# EAGLE schematic MS14-N.v1.4 (EAGLE 7.5.0)

## Sheet 1 of 5
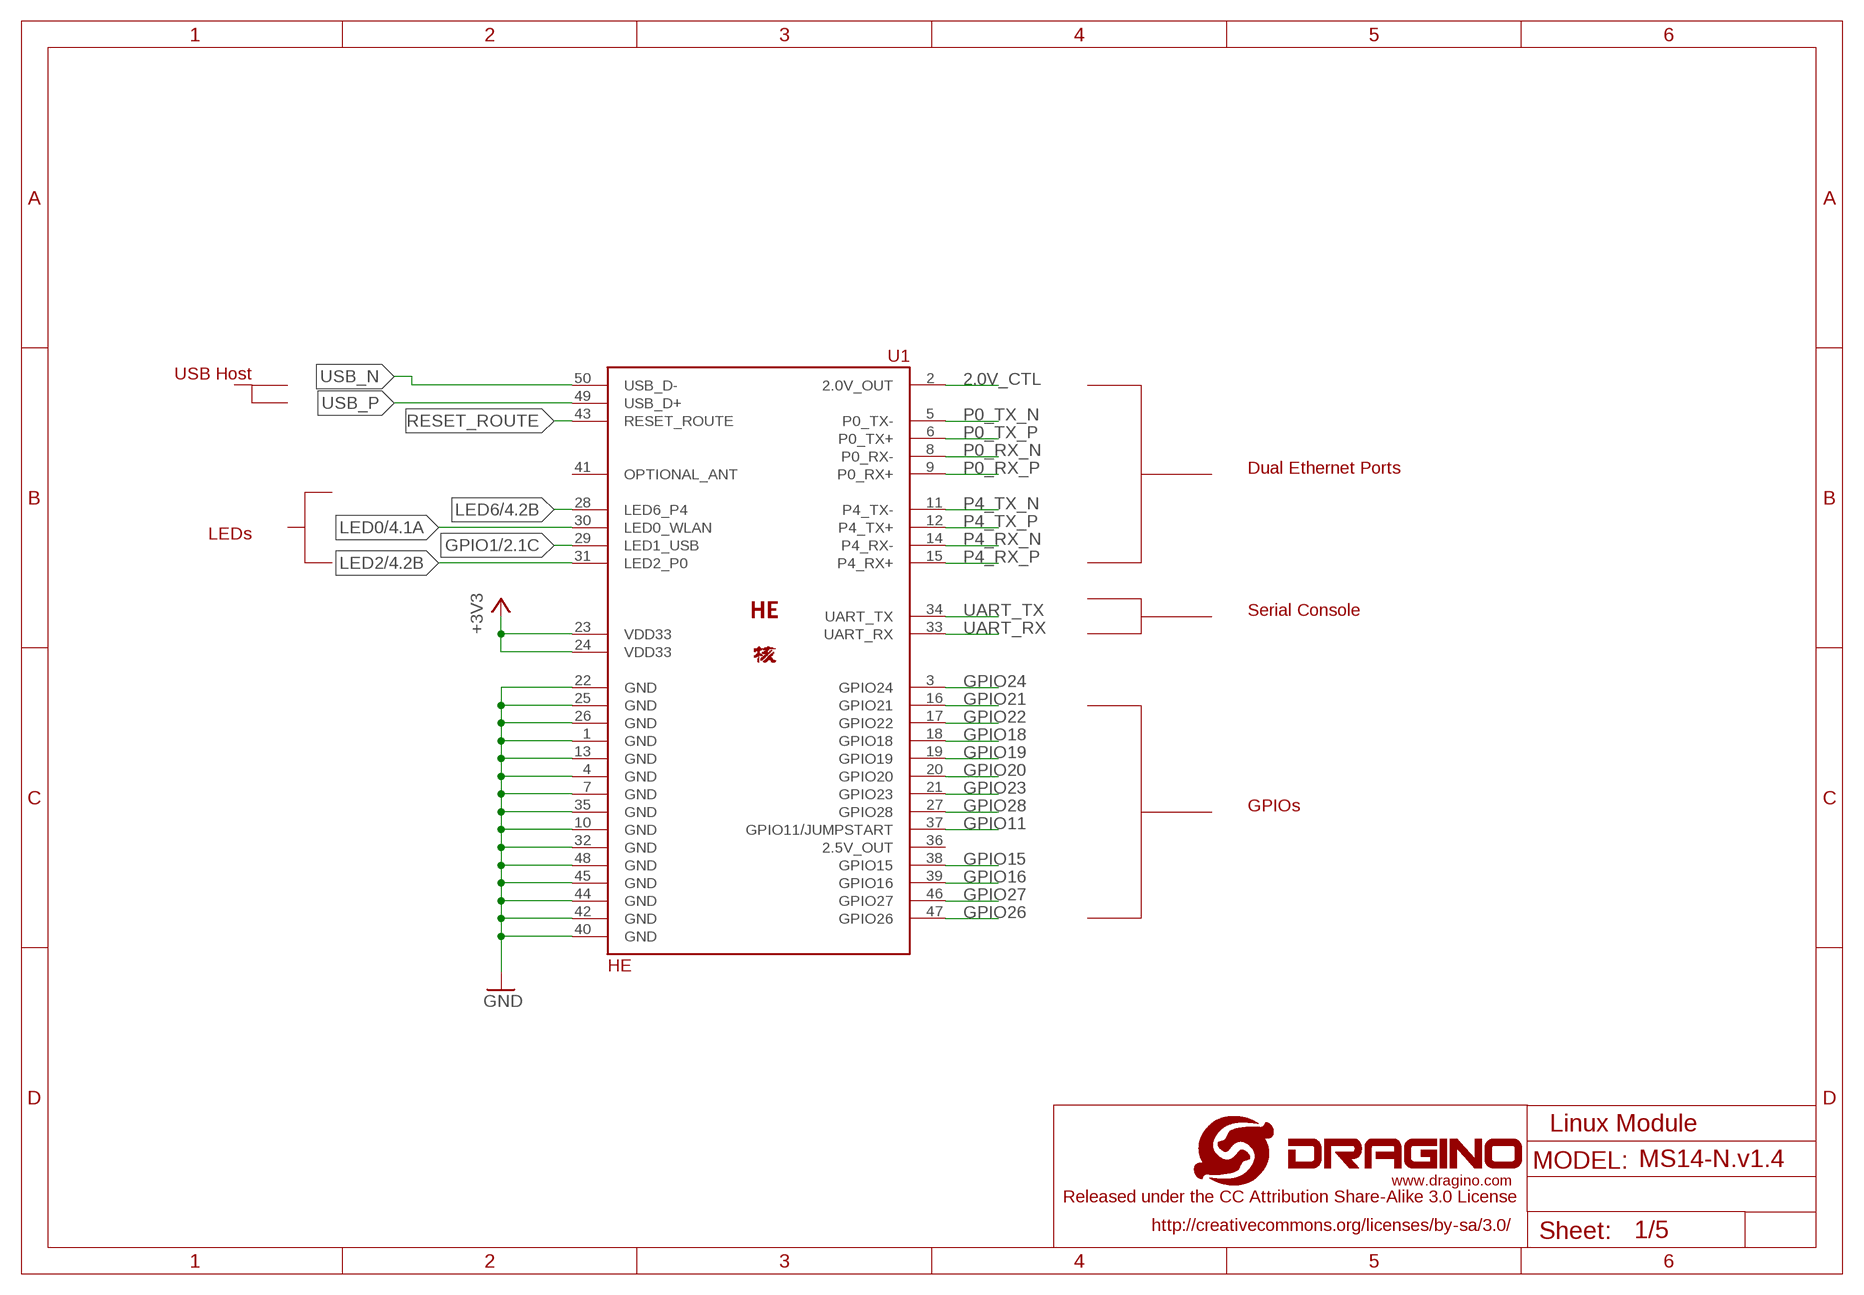
[diagram p0: schematic, sheet 1]

### Parts
U1  HE  [HE50]

### Nets
2.0V_CTL: U1.2(2.0V_OUT) ; also sheet 3
+3V3: U1.23(VDD33) U1.24(VDD33) ; also sheet 2,4
GND [gnd]: U1.1(GND) U1.4(GND) U1.7(GND) U1.10(GND) U1.13(GND) U1.22(GND) U1.25(GND) U1.26(GND) U1.32(GND) U1.35(GND) U1.40(GND) U1.42(GND) U1.44(GND) U1.45(GND) U1.48(GND) ; also sheet 2,3,4,5
GPIO1: U1.29(LED1_USB) ; also sheet 2
GPIO11: U1.37(GPIO11/JUMPSTART) ; also sheet 4
GPIO15: U1.38(GPIO15) ; also sheet 4
GPIO16: U1.39(GPIO16) ; also sheet 4
GPIO18: U1.18(GPIO18) ; also sheet 4
GPIO19: U1.19(GPIO19) ; also sheet 4
GPIO20: U1.20(GPIO20) ; also sheet 4
GPIO21: U1.16(GPIO21) ; also sheet 4
GPIO22: U1.17(GPIO22) ; also sheet 4
GPIO23: U1.21(GPIO23) ; also sheet 4
GPIO24: U1.3(GPIO24) ; also sheet 4
GPIO26: U1.47(GPIO26) ; also sheet 4
GPIO27: U1.46(GPIO27) ; also sheet 4
GPIO28: U1.27(GPIO28) ; also sheet 4
LED0: U1.30(LED0_WLAN) ; also sheet 4
LED2: U1.31(LED2_P0) ; also sheet 4
LED6: U1.28(LED6_P4) ; also sheet 4
P0_RX_N: U1.8(P0_RX-) ; also sheet 3
P0_RX_P: U1.9(P0_RX+) ; also sheet 3
P0_TX_N: U1.5(P0_TX-) ; also sheet 3
P0_TX_P: U1.6(P0_TX+) ; also sheet 3
P4_RX_N: U1.14(P4_RX-) ; also sheet 3
P4_RX_P: U1.15(P4_RX+) ; also sheet 3
P4_TX_N: U1.11(P4_TX-) ; also sheet 3
P4_TX_P: U1.12(P4_TX+) ; also sheet 3
RESET_ROUTE: U1.43(RESET_ROUTE) ; also sheet 4
UART_RX: U1.33(UART_RX) ; also sheet 4
UART_TX: U1.34(UART_TX) ; also sheet 4
USB_N: U1.50(USB_D-) ; also sheet 5
USB_P: U1.49(USB_D+) ; also sheet 5
Unconnected: U1.36(2.5V_OUT)

### Notes on the sheet
- USB Host
- Dual Ethernet Ports
- LEDs
- Serial Console
- GPIOs
- Linux Module

## Sheet 2 of 5
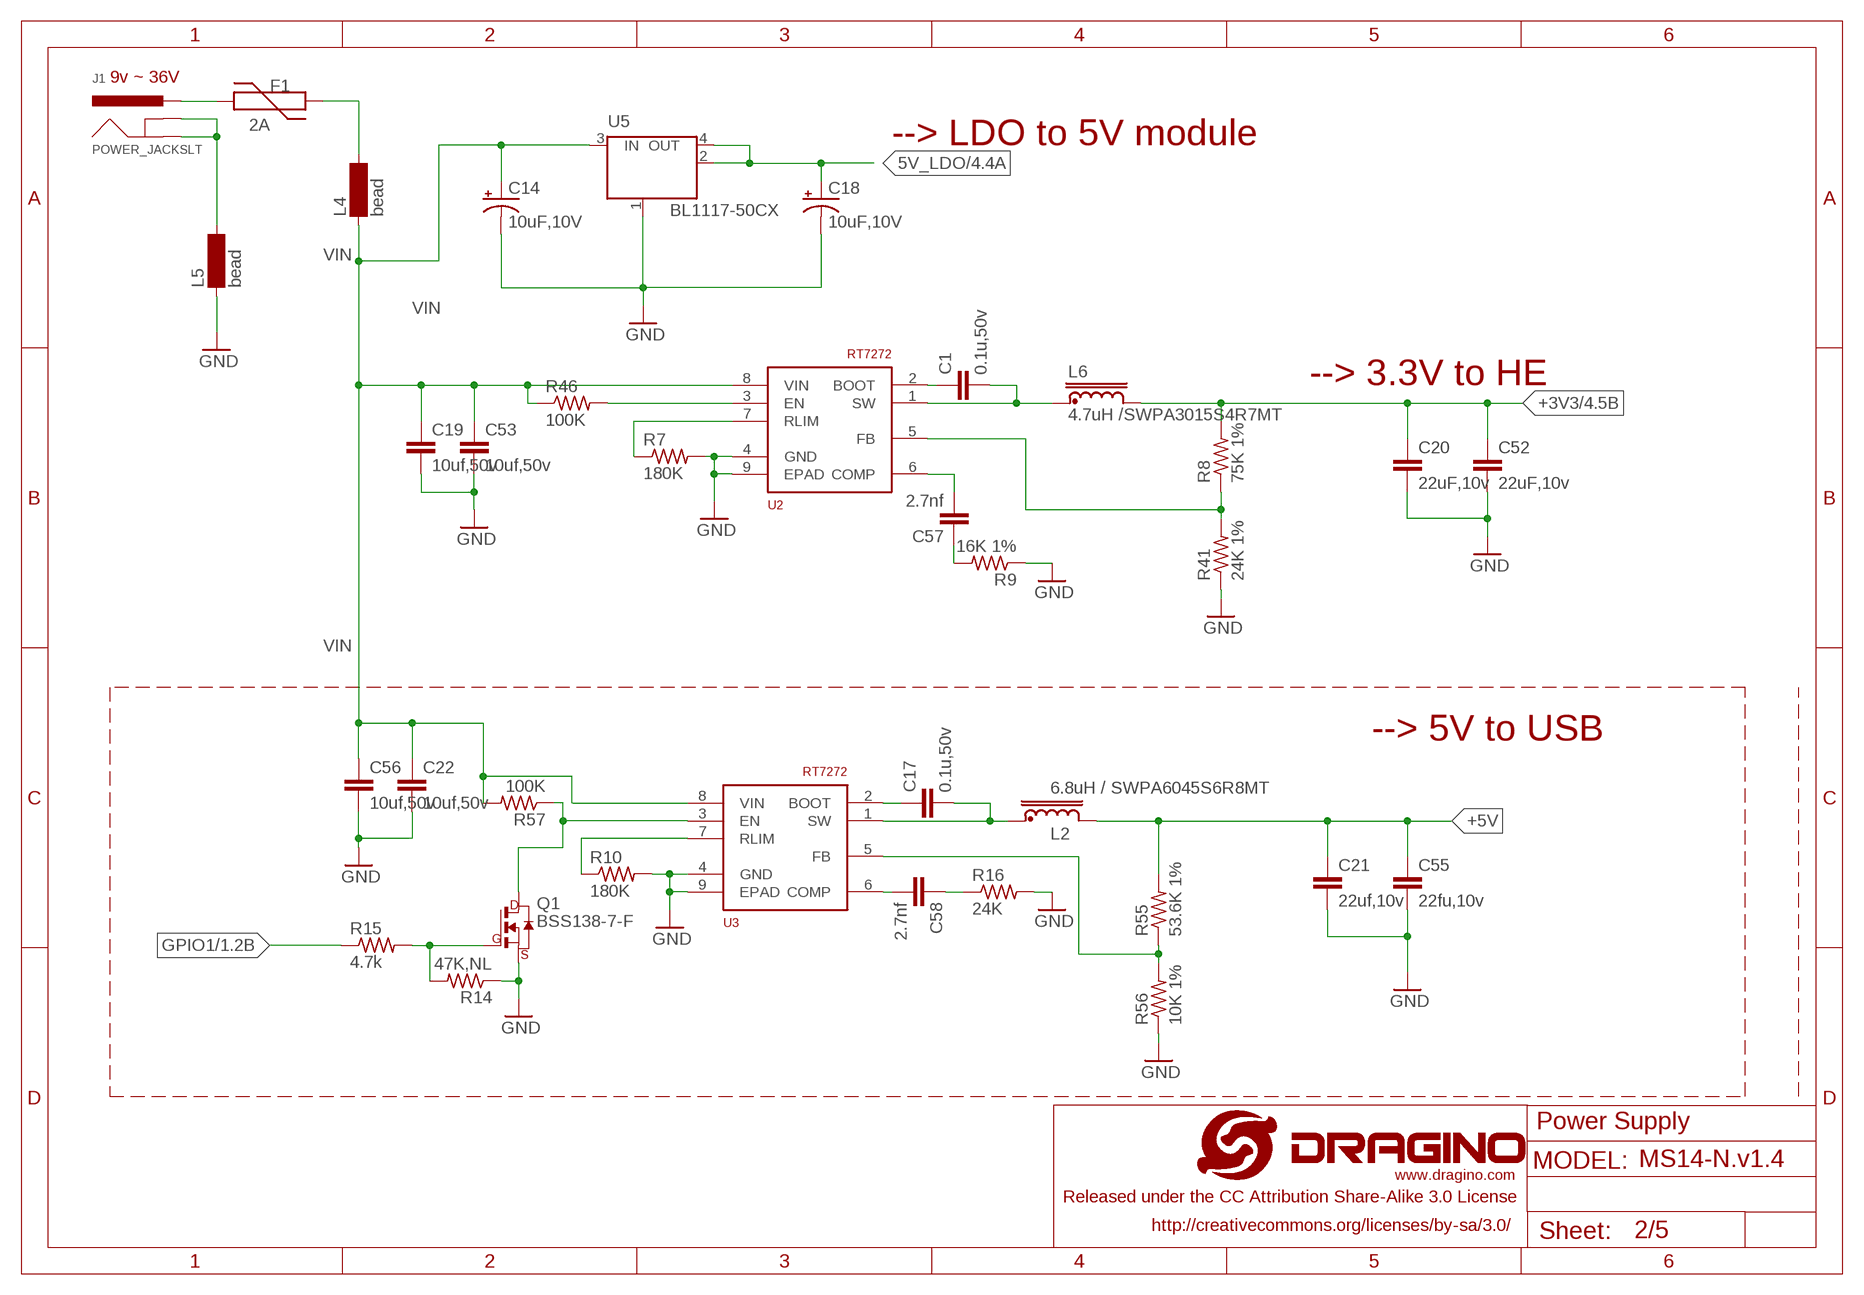
[diagram p1: schematic, sheet 2]

### Parts
C1  0.1u,50v  C-EUC0402  [C0402]
C14  10uF,10V  CPOL-USSMCA  [SMC_A]
C17  0.1u,50v  C-EUC0402  [C0402]
C18  10uF,10V  CPOL-USSMCA  [SMC_A]
C19  10uf,50v  C-EUC1206K  [C1206K]
C20  22uF,10v  C-EUC1210  [C1210]
C21  22uf,10v  C-EUC1210  [C1210]
C22  10uf,50v  C-EUC1206K  [C1206K]
C52  22uF,10v  C-EUC1210  [C1210]
C53  10uf,50v  C-EUC1206K  [C1206K]
C55  22fu,10v  C-EUC1210  [C1210]
C56  10uf,50v  C-EUC1206K  [C1206K]
C57  2.7nf  C-EUC0402  [C0402]
C58  2.7nf  C-EUC0402  [C0402]
F1  2A  FUSE1812  [L1812]
J1  POWER_JACKSLT  [POWER_JACK_SLOT]
L2  6.8uH / SWPA6045S6R8MT  INDUCTOR6028S  [SWPA6028S]
L4  bead  BS11  [BS11]
L5  bead  BS11  [BS11]
L6  4.7uH /SWPA3015S4R7MT  INDUCTORSWPA3010S  [SWPA3010S]
Q1  BSS138-7-F  NMOSFET  [SOT-23]
R7  180K  R-US_R0402  [R0402]
R8  75K 1%  R-US_R0402  [R0402]
R9  16K 1%  R-US_R0402  [R0402]
R10  180K  R-US_R0402  [R0402]
R14  47K,NL  R-US_R0402  [R0402]
R15  4.7k  R-US_R0402  [R0402]
R16  24K  R-US_R0402  [R0402]
R41  24K 1%  R-US_R0402  [R0402]
R46  100K  R-US_R0402  [R0402]
R55  53.6K 1%  R-US_R0402  [R0402]
R56  10K 1%  R-US_R0402  [R0402]
R57  100K  R-US_R0402  [R0402]
U2  RT7272  [RT8250-SOP8]
U3  RT7272  [RT8250-SOP8]
U5  BL1117-50CX  MC33269ST-3.3T3  [SOT223]

### Nets
5V_LDO: C18.+ U5.2(OUT) U5.4(OUT) ; also sheet 4
+3V3: C20.1 C52.1 L6.P$2 R8.2 ; also sheet 1,4
+5V: C21.1 C55.1 L2.P$2 R55.2 ; also sheet 4,5
GND [gnd]: C14.- C18.- C19.2 C20.2 C21.2 C22.2 C52.2 C53.2 C55.2 C56.2 L5.1 Q1.2(S) R7.2 R9.1 R10.2 R14.1 R16.2 R41.1 R56.1 U2.4(GND) U2.9(EPAD) U3.4(GND) U3.9(EPAD) U5.1(GND/ADJ) ; also sheet 1,3,4,5
GPIO1: R15.1 ; also sheet 1
N$2: J1.GND@1(GNDBREAK) J1.GND@2(GND) L5.2
N$3: F1.2 L4.2
N$12: F1.1 J1.PWR
N$16: Q1.1(D) R57.1 U3.3(EN)
N$17: R10.1 U3.7(RLIM)
N$19: Q1.3(G) R14.2 R15.2
N$20: C58.2 U3.6(COMP)
N$22 [gnd]: R55.1 R56.2 U3.5(FB)
N$24: C1.2 L6.P$1 U2.1(SW)
N$25: R46.2 U2.3(EN)
N$26: R7.1 U2.7(RLIM)
N$27: C1.1 U2.2(BOOT)
N$29: C57.1 R9.2
N$31: C57.2 U2.6(COMP)
N$32: C58.1 R16.1
N$34: C17.2 L2.P$1 U3.1(SW)
N$49: R8.1 R41.2 U2.5(FB)
N$55: C17.1 U3.2(BOOT)
VIN: C14.+ C19.1 C22.1 C53.1 C56.1 L4.1 R46.1 R57.2 U2.8(VIN) U3.8(VIN) U5.3(IN) ; also sheet 4

### Notes on the sheet
- 9v ~ 36V
- --> LDO to 5V module
- --> 3.3V to HE
- --> 5V to USB
- Power Supply

## Sheet 3 of 5
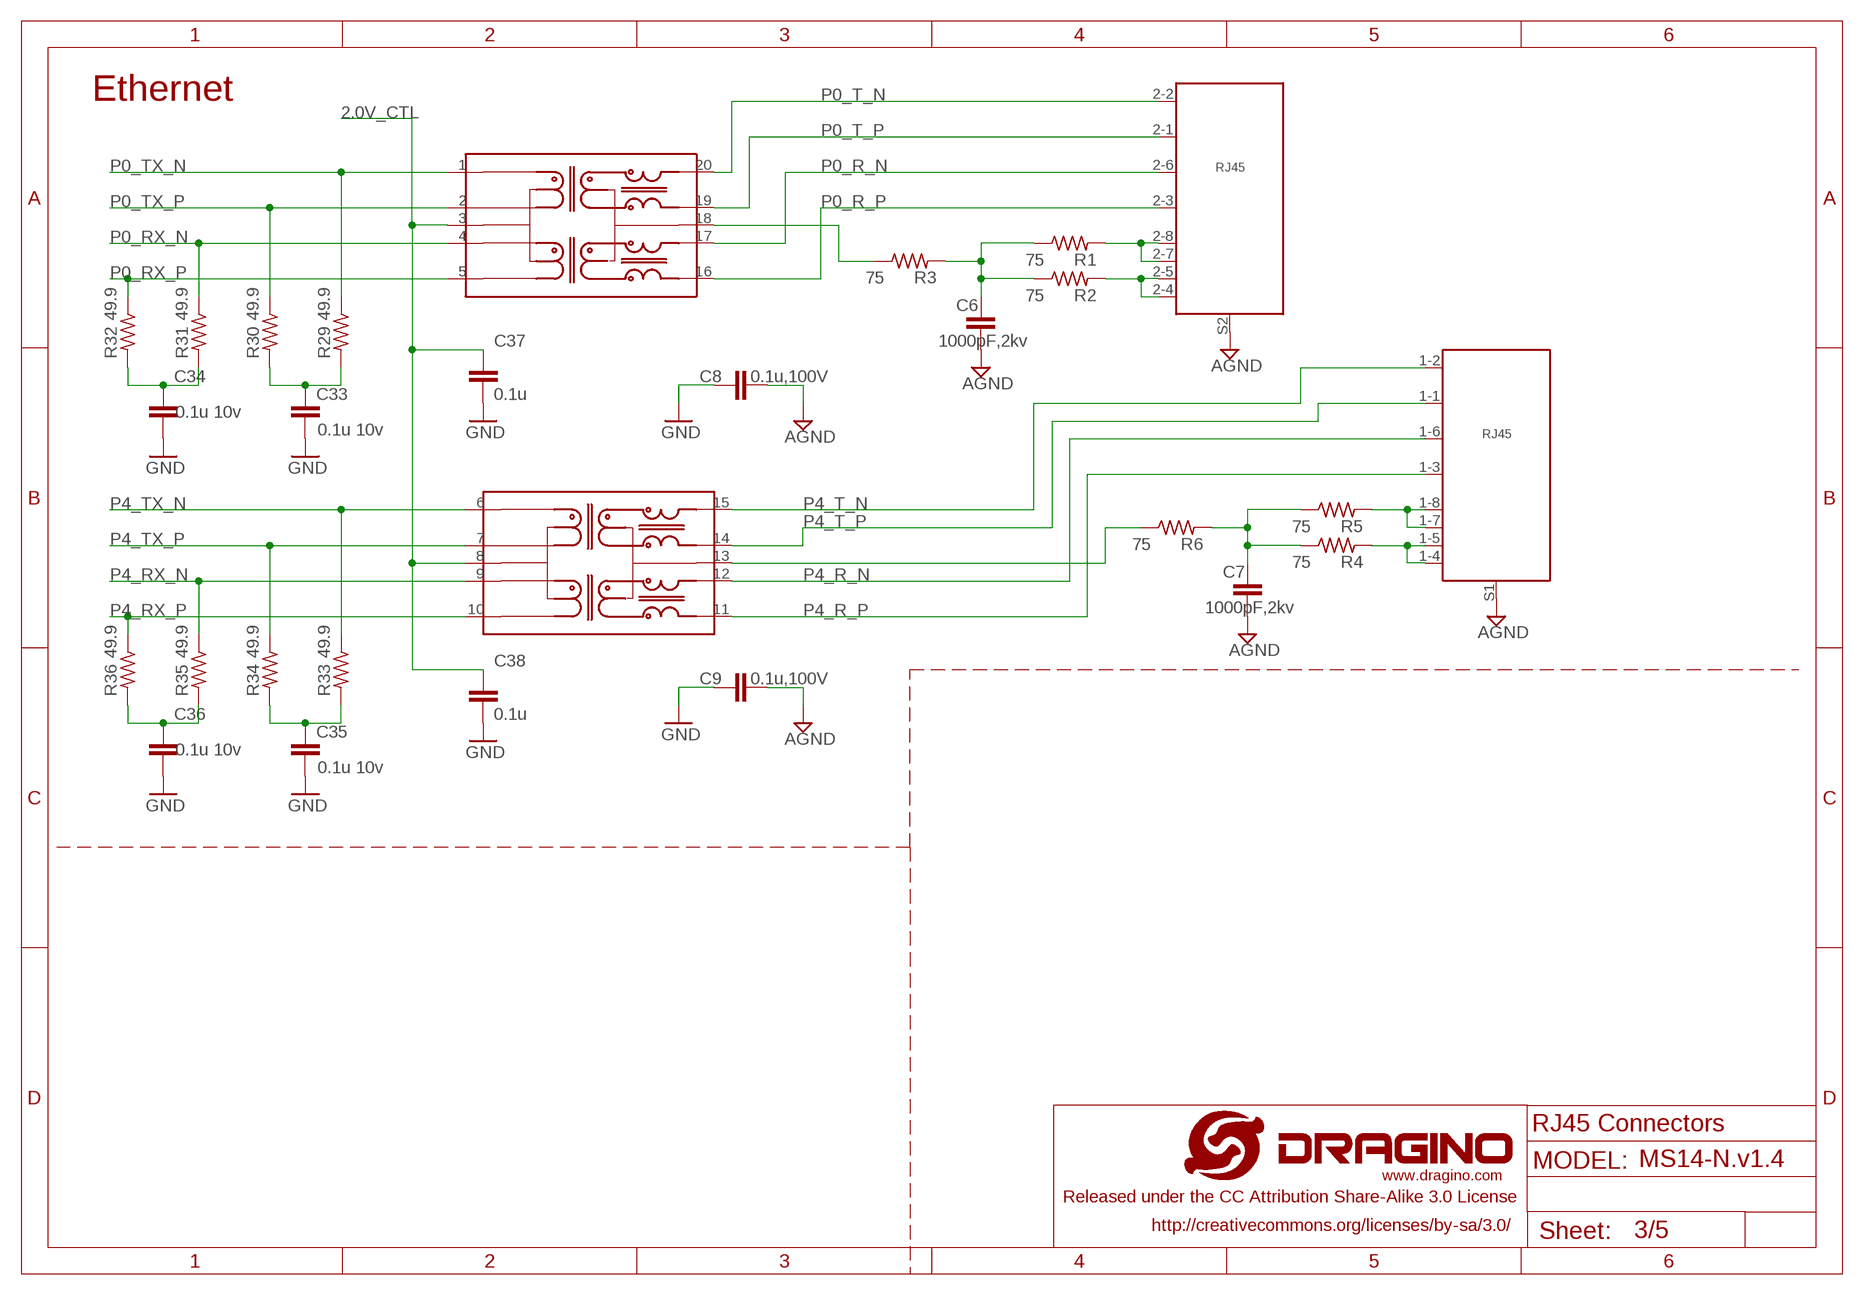
[diagram p2: schematic, sheet 3]

### Parts
C6  1000pF,2kv  C-EUC1206  [C1206]
C7  1000pF,2kv  C-EUC1206  [C1206]
C8  0.1u,100V  C-EUC0805  [C0805]
C9  0.1u,100V  C-EUC0805  [C0805]
C33  0.1u 10v  C-EUC0402  [C0402]
C34  0.1u 10v  C-EUC0402  [C0402]
C35  0.1u 10v  C-EUC0402  [C0402]
C36  0.1u 10v  C-EUC0402  [C0402]
C37  0.1u  C-EUC0402  [C0402]
C38  0.1u  C-EUC0402  [C0402]
J2  ETHERNET_2PORT  [ETHERNET-1X2]
R1  75  R-US_R0402  [R0402]
R2  75  R-US_R0402  [R0402]
R3  75  R-US_R0402  [R0402]
R4  75  R-US_R0402  [R0402]
R5  75  R-US_R0402  [R0402]
R6  75  R-US_R0402  [R0402]
R29  49.9  R-US_R0402  [R0402]
R30  49.9  R-US_R0402  [R0402]
R31  49.9  R-US_R0402  [R0402]
R32  49.9  R-US_R0402  [R0402]
R33  49.9  R-US_R0402  [R0402]
R34  49.9  R-US_R0402  [R0402]
R35  49.9  R-US_R0402  [R0402]
R36  49.9  R-US_R0402  [R0402]
T1  RJ45_TRANSFORMER_HST2038DR  [RIONET_H2038]

### Nets
2.0V_CTL: C37.1 C38.1 T1.3(CT1) T1.8(CT1) ; also sheet 1
AGND: C6.2 C7.2 C8.2 C9.2 J2.S1(SHIELD) J2.S2(SHIELD)
GND [gnd]: C8.1 C9.1 C33.2 C34.2 C35.2 C36.2 C37.2 C38.2 ; also sheet 1,2,4,5
N$7: R6.1 T1.13(CT2)
N$39: C35.1 R33.2 R34.2
N$40: C36.1 R35.2 R36.2
N$41: J2.2-7 J2.2-8 R1.2
N$42: J2.2-4 J2.2-5 R2.2
N$43: C33.1 R29.2 R30.2
N$44: C34.1 R31.2 R32.2
N$45: R3.1 T1.18(CT2)
N$46: C6.1 R1.1 R2.1 R3.2
N$51: J2.1-7 J2.1-8 R5.2
N$52: J2.1-4 J2.1-5 R4.2
N$54: C7.1 R4.1 R5.1 R6.2
P0_R_N: J2.2-6 T1.17(RX+)
P0_R_P: J2.2-3 T1.16(RX-)
P0_RX_N: R31.1 T1.4(RD+) ; also sheet 1
P0_RX_P: R32.1 T1.5(RD-) ; also sheet 1
P0_T_N: J2.2-2 T1.20(TX+)
P0_T_P: J2.2-1 T1.19(TX-)
P0_TX_N: R29.1 T1.1(TD+) ; also sheet 1
P0_TX_P: R30.1 T1.2(TD-) ; also sheet 1
P4_R_N: J2.1-6 T1.12(RX+)
P4_R_P: J2.1-3 T1.11(RX-)
P4_RX_N: R35.1 T1.9(RD+) ; also sheet 1
P4_RX_P: R36.1 T1.10(RD-) ; also sheet 1
P4_T_N: J2.1-2 T1.15(TX+)
P4_T_P: J2.1-1 T1.14(TX-)
P4_TX_N: R33.1 T1.6(TD+) ; also sheet 1
P4_TX_P: R34.1 T1.7(TD-) ; also sheet 1

### Notes on the sheet
- Ethernet
- RJ45 Connectors

## Sheet 4 of 5
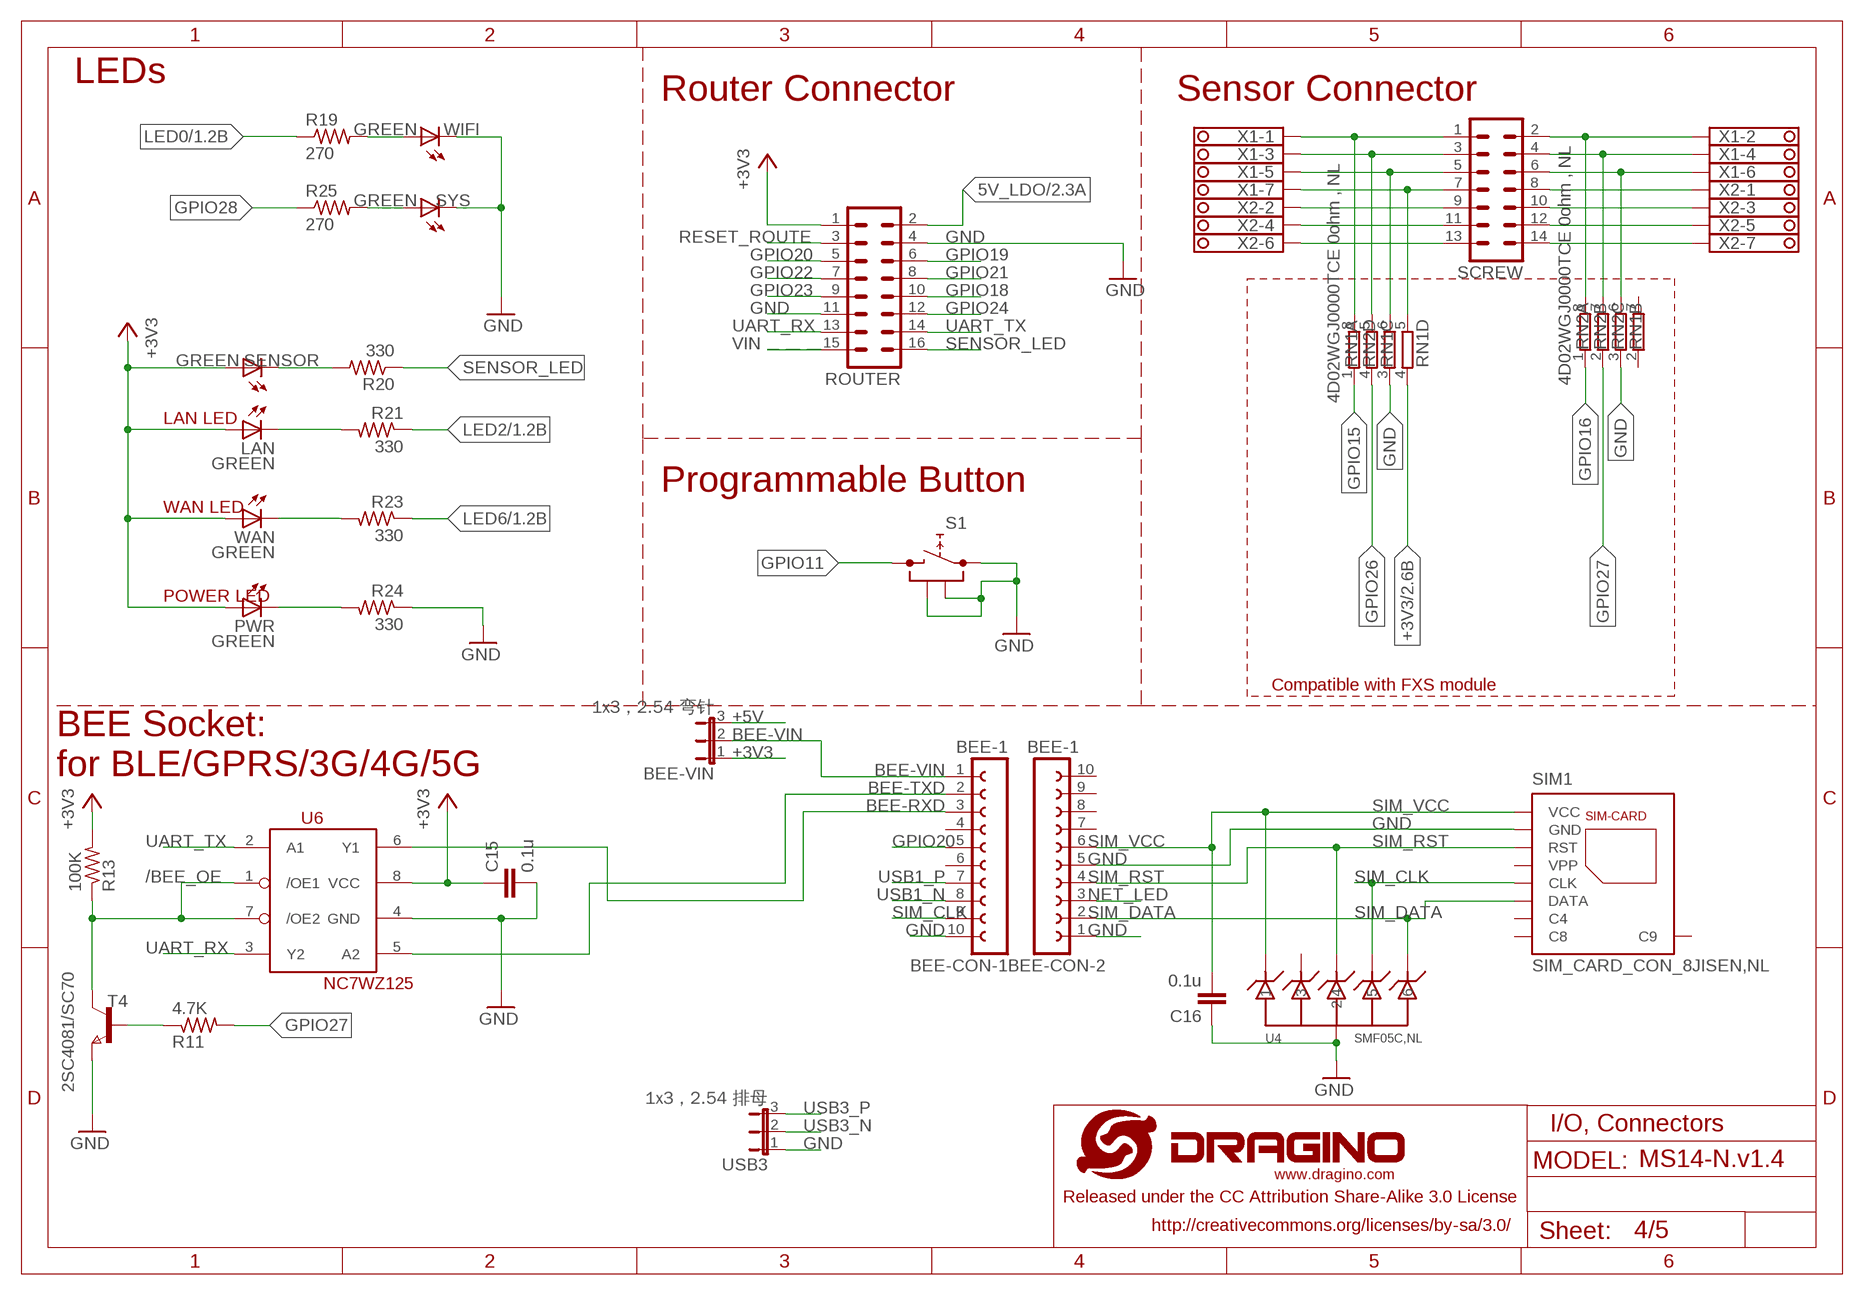
[diagram p3: schematic, sheet 4]

### Parts
BEE-CON-1  BEE-1  CON-10P10P-2.0  [10P-2.0MM]
BEE-CON-2  BEE-1  CON-10P10P-2.0  [10P-2.0MM]
BEE-VIN  1x3 , 2.54 弯针  JP2E  [JP2]
C15  0.1u  C-EUC0402  [C0402]
C16  0.1u  C-EUC0402  [C0402]
LAN  GREEN  LEDCHIP-LED0805  [CHIP-LED0805]
PWR  GREEN  LEDCHIP-LED0805  [CHIP-LED0805]
R11  4.7K  R-US_R0402  [R0402]
R13  100K  R-US_R0402  [R0402]
R19  270  R-US_R0402  [R0402]
R20  330  R-US_R0402  [R0402]
R21  330  R-US_R0402  [R0402]
R23  330  R-US_R0402  [R0402]
R24  330  R-US_R0402  [R0402]
R25  270  R-US_R0402  [R0402]
RN1  4D02WGJ0000TCE 0ohm , NL  4R-N0402ARV341  [4X0402ARV341]
RN2  4D02WGJ0000TCE 0ohm , NL  4R-N0402ARV341  [4X0402ARV341]
ROUTER  MA08-2  [MA08-2]
S1  PUSH_SWITCH  [SWITCH_6X6X5]
SCREW  MA07-2  [MA07-2]
SENSOR  GREEN  LEDCHIP-LED0805  [CHIP-LED0805]
SIM1  SIM_CARD_CON_8JISEN,NL  SIM_CARD_CON_8JISEN  [SIM-0002]
SYS  GREEN  LEDCHIP-LED0805  [CHIP-LED0805]
T4  2SC4081/SC70  NPNSOT323  [SOT323]
U4  SMF05C,NL  SMF05C  [SOT363]
U6  NC7WZ125  [US8]
USB3  1x3 , 2.54 排母  JP2E  [JP2]
WAN  GREEN  LEDCHIP-LED0805  [CHIP-LED0805]
WIFI  GREEN  LEDCHIP-LED0805  [CHIP-LED0805]
X1  1751293  [1751293]
X2  1751293  [1751293]

### Nets
5V_LDO: ROUTER.2 ; also sheet 2
+3V3: BEE-VIN.1 C15.1 LAN.A PWR.A R13.2 RN1.4 ROUTER.1 SENSOR.A U6.8(VCC) WAN.A ; also sheet 1,2
+5V: BEE-VIN.3 ; also sheet 2,5
/BEE_OE: R13.1 T4.1(C) U6.1(/OE1) U6.7(/OE2)
BEE-RXD: BEE-CON-1.3 U6.6(Y1)
BEE-TXD: BEE-CON-1.2 U6.5(A2)
BEE-VIN: BEE-CON-1.1 BEE-VIN.2
GND [gnd]: BEE-CON-1.10 BEE-CON-2.1 BEE-CON-2.5 C15.2 C16.1 R24.1 RN1.3 RN2.3 ROUTER.4 ROUTER.11 S1.1 S1.3 S1.4 SIM1.C5(GND) SYS.C T4.3(E) U4.2 U6.4(GND) USB3.1 WIFI.C ; also sheet 1,2,3,5
GPIO11: S1.2 ; also sheet 1
GPIO15: RN1.1 ; also sheet 1
GPIO16: RN2.1 ; also sheet 1
GPIO18: ROUTER.10 ; also sheet 1
GPIO19: ROUTER.6 ; also sheet 1
GPIO20: BEE-CON-1.5 ROUTER.5 ; also sheet 1
GPIO21: ROUTER.8 ; also sheet 1
GPIO22: ROUTER.7 ; also sheet 1
GPIO23: ROUTER.9 ; also sheet 1
GPIO24: ROUTER.12 ; also sheet 1
GPIO26: RN2.4 ; also sheet 1
GPIO27: R11.2 RN2.2 ; also sheet 1
GPIO28: R25.1 ; also sheet 1
LED0: R19.1 ; also sheet 1
LED2: R21.1 ; also sheet 1
LED6: R23.1 ; also sheet 1
N$1: R25.2 SYS.A
N$4: R11.1 T4.2(B)
N$5: RN1.8 SCREW.1 X1.1
N$6: RN2.8 SCREW.2 X1.2
N$8: RN2.5 SCREW.3 X1.3
N$9: RN2.7 SCREW.4 X1.4
N$10: RN1.6 SCREW.5 X1.5
N$11: RN2.6 SCREW.6 X1.6
N$13: R20.2 SENSOR.C
N$14: RN1.5 SCREW.7 X1.7
N$15: SCREW.8 X2.1
N$23: R19.2 WIFI.A
N$30: LAN.C R21.2
N$33: SCREW.9 X2.2
N$35: PWR.C R24.2
N$36: SCREW.10 X2.3
N$37: SCREW.11 X2.4
N$38: SCREW.13 X2.6
N$47: SCREW.14 X2.7
N$48: SCREW.12 X2.5
NET_LED: BEE-CON-2.3
RESET_ROUTE: ROUTER.3 ; also sheet 1
SENSOR_LED: R20.1 ROUTER.16
SIM_CLK: BEE-CON-1.9 SIM1.C3(CLK) U4.5
SIM_DATA: BEE-CON-2.2 SIM1.C7(DATA) U4.6
SIM_RST: BEE-CON-2.4 SIM1.C2(RST) U4.4
SIM_VCC: BEE-CON-2.6 C16.2 SIM1.C1(VCC) U4.1
UART_RX: ROUTER.13 U6.3(Y2) ; also sheet 1
UART_TX: ROUTER.14 U6.2(A1) ; also sheet 1
USB1_N: BEE-CON-1.8 ; also sheet 5
USB1_P: BEE-CON-1.7 ; also sheet 5
USB3_N: USB3.2 ; also sheet 5
USB3_P: USB3.3 ; also sheet 5
VIN: ROUTER.15 ; also sheet 2
YELLOW: R23.2 WAN.C
Unconnected: BEE-CON-1.4 BEE-CON-1.6 BEE-CON-2.7 BEE-CON-2.8 BEE-CON-2.9 BEE-CON-2.10 RN1.2 RN1.7 SIM1.C4 SIM1.C6(VPP) SIM1.C8 SIM1.C9 U4.3

### Notes on the sheet
- LEDs
- Router Connector | Sensor Connector
- LAN LED
- Programmable Button
- WAN LED
- POWER LED
- Compatible with FXS module
- BEE Socket: 
  for BLE/GPRS/3G/4G/5G
- I/O, Connectors

## Sheet 5 of 5
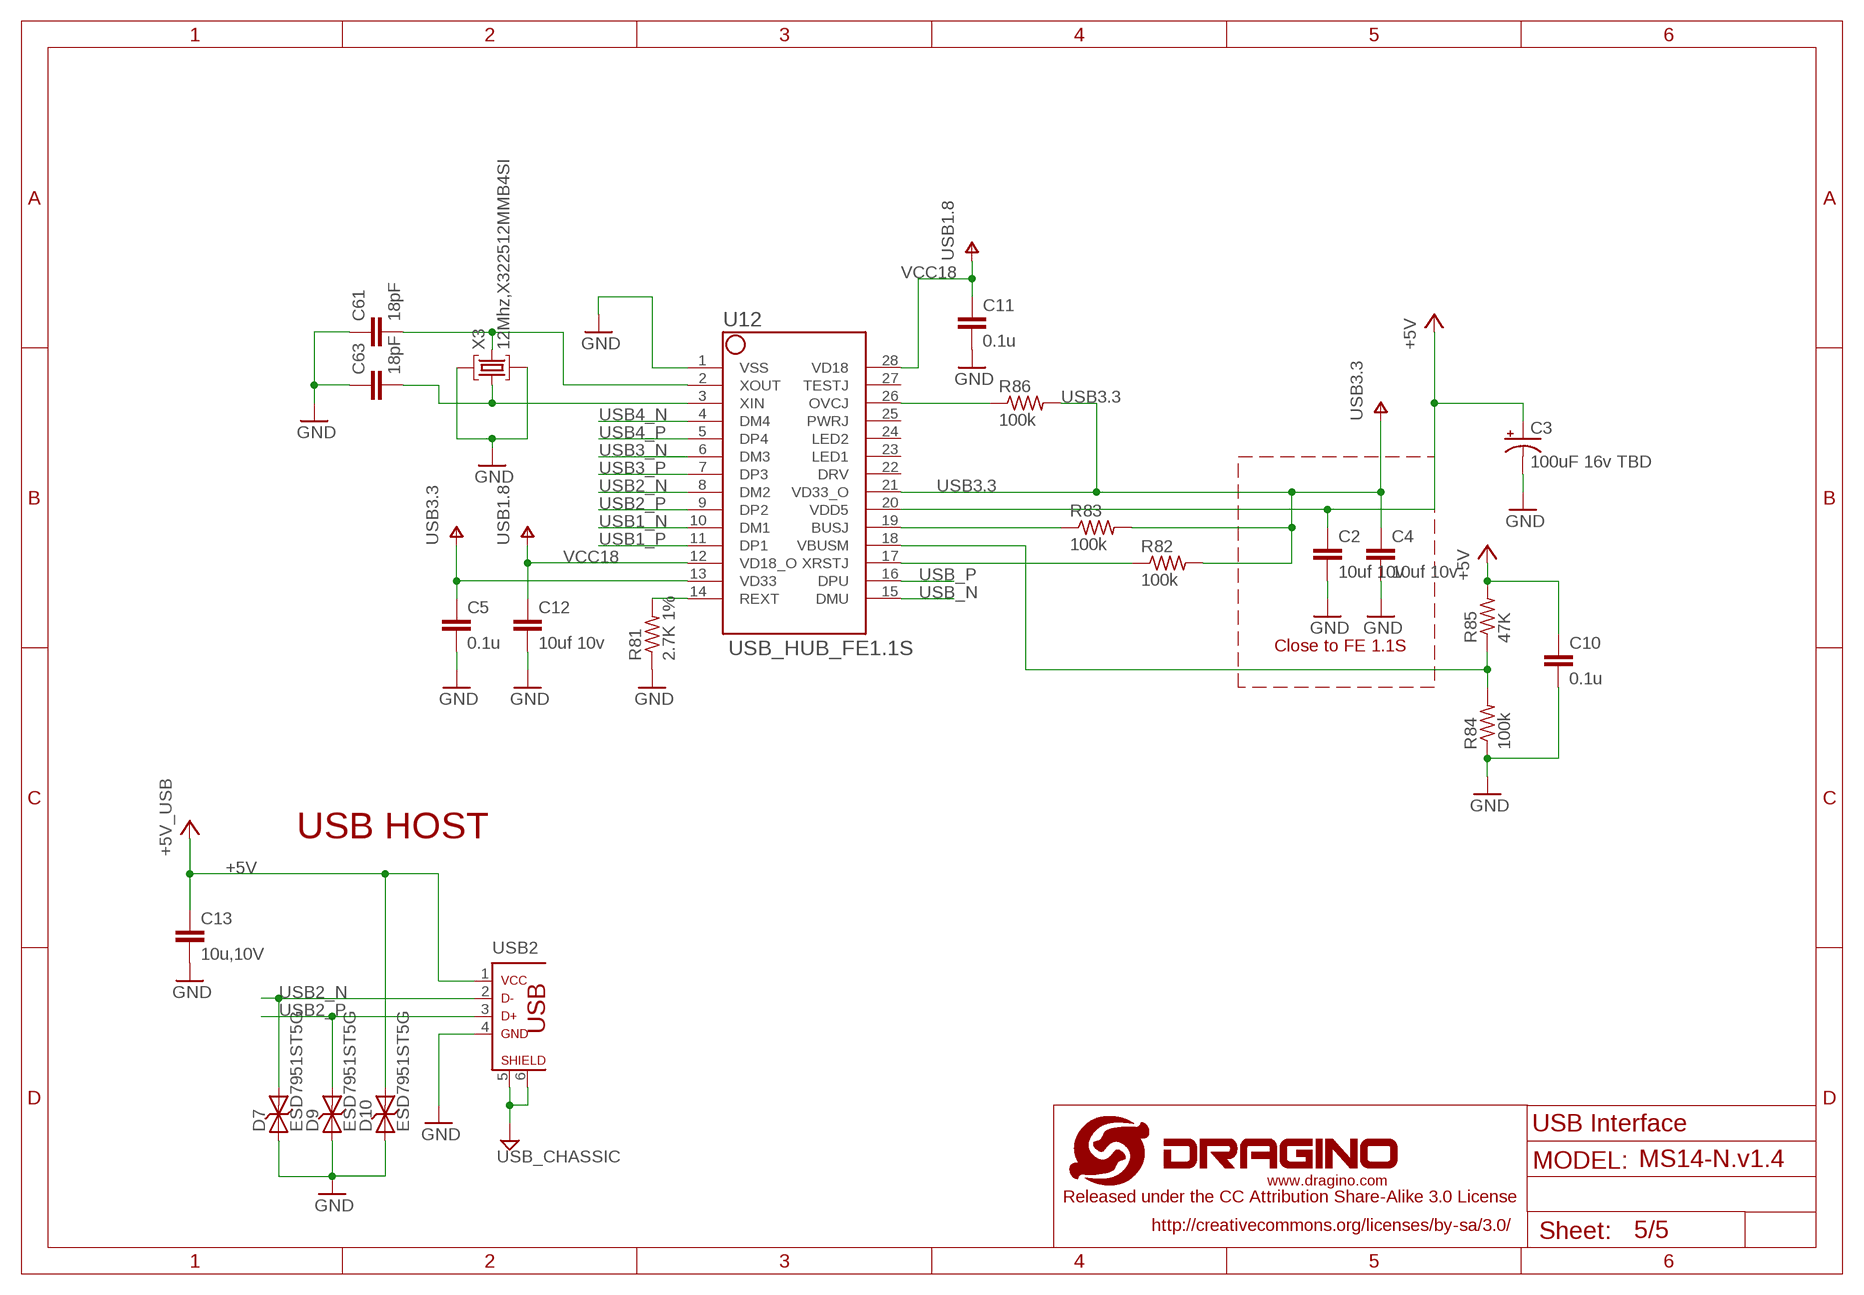
[diagram p4: schematic, sheet 5]

### Parts
C2  10uf 10v  C-EUC0603  [C0603]
C3  100uF 16v TBD  CPOL-USUD-6,3X5,8  [UD-6,3X5,8_NICHICON]
C4  10uf 10v  C-EUC0603  [C0603]
C5  0.1u  C-EUC0402  [C0402]
C10  0.1u  C-EUC0402  [C0402]
C11  0.1u  C-EUC0402  [C0402]
C12  10uf 10v  C-EUC0603  [C0603]
C13  10u,10V  C-EUC0805  [C0805]
C61  18pF  C-EUC0402  [C0402]
C63  18pF  C-EUC0402  [C0402]
D7  ESD7951ST5G  TVSSOD−923  [SOD−923]
D9  ESD7951ST5G  TVSSOD−923  [SOD−923]
D10  ESD7951ST5G  TVSSOD−923  [SOD−923]
R81  2.7K 1%  R-US_R0402  [R0402]
R82  100k  R-US_R0402  [R0402]
R83  100k  R-US_R0402  [R0402]
R84  100k  R-US_R0402  [R0402]
R85  47K  R-US_R0402  [R0402]
R86  100k  R-US_R0402  [R0402]
U12  USB_HUB_FE1.1S  [USB_HUB_FE1.1S]
USB2  USB_C42562  [USB_C42562]
X3  12Mhz,X322512MMB4SI  CRYSTAL  [SMARTPRJ_CRYSTAL-3.2-2.5]

### Nets
+5V: C2.1 C3.+ C10.1 C13.1 D10.P$2 R85.2 U12.20(VDD5) USB2.1 ; supply symbol labelled +5V_USB ; also sheet 2,4
CLK_N: C63.2 U12.3(XIN) X3.1(C1)
CLK_P: C61.2 U12.2(XOUT) X3.3(C2)
GND [gnd]: C2.2 C3.- C4.2 C5.2 C10.2 C11.2 C12.2 C13.2 C61.1 C63.1 D7.P$1 D9.P$1 D10.P$1 R81.1 R84.1 U12.1(VSS) USB2.4 X3.2(GND) X3.4(GND) ; also sheet 1,2,3,4
N$18: R86.1 U12.26(OVCJ)
N$109: R81.2 U12.14(REXT)
N$111: R82.1 U12.17(XRSTJ)
N$112: R83.1 U12.19(BUSJ)
N$113: R84.2 R85.1 U12.18(VBUSM)
USB1_N: U12.10(DM1) ; also sheet 4
USB1_P: U12.11(DP1) ; also sheet 4
USB2_N [usbtrace-4layer]: D7.P$2 U12.8(DM2) USB2.2
USB2_P [usbtrace-4layer]: D9.P$2 U12.9(DP2) USB2.3
USB3.3: C4.1 C5.1 R82.2 R83.2 R86.2 U12.13(VD33) U12.21(VD33_O)
USB3_N: U12.6(DM3) ; also sheet 4
USB3_P: U12.7(DP3) ; also sheet 4
USB4_N: U12.4(DM4)
USB4_P: U12.5(DP4)
USB_GND [gnd]: USB2.5 USB2.6 ; supply symbol labelled USB_CHASSIC
USB_N: U12.15(DMU) ; also sheet 1
USB_P: U12.16(DPU) ; also sheet 1
VCC18: C11.1 C12.1 U12.12(VD18_O) U12.28(VD18) ; supply symbol labelled USB1.8
Unconnected: U12.22(DRV) U12.23(LED1) U12.24(LED2) U12.25(PWRJ) U12.27(TESTJ)

### Notes on the sheet
- Close to FE 1.1S
- USB HOST
- USB Interface

## Power pins joined to a net without a drawn wire
OPTIONAL_ANT: U1.41(OPTIONAL_ANT)

## Library data of the parts
BEE-CON-1 BEE-CON-2 = dragino-passive:CON-10P: FEMALE HEADER
BEE-VIN USB3 = dragino:JP2E: JUMPER
C1 C6-C9 C13 C17 C19-C22 C33-C38 C52 C53 C55-C58 = dragino:C-EU: CAPACITOR, European symbol
C2 C4 C5 C10-C12 C15 C16 C61 C63 = dragino-passive:C-EU: CAPACITOR, European symbol
C3 = dragino:CPOL-US: POLARIZED CAPACITOR, American symbol
C14 C18 = rcl:CPOL-US: POLARIZED CAPACITOR, American symbol
D7 D9 D10 = dragino:TVS: DIODE
F1 = dragino:FUSE: FUSE 5 x 20 mm
J1 = dragino:POWER_JACK: Power Jack This is the standard 5.5mm barrel jack for power. The PTH is the most common, proven, reliable, footprint. All others are experimental. The Slot footprint only works if the mill layer is transmitted to the PCB fab house so be warned. Spark Fun Electronics SKU : PRT-00119. Mating wall wart : TOL-00298 (and others)
J2 = dragino:ETHERNET_2PORT
L2 = dragino-passive:INDUCTOR: CHOKE U15
L4 L5 = inductor-neosid:BS: INDUCTOR nominal inductance, magnetically screened; OC_FARNELL: unknown; OC_NEWARK: unknown
L6 = dragino:INDUCTOR: CHOKE U15
LAN PWR SENSOR SYS WAN WIFI = dragino:LED: LED OSRAM: - CHIPLED LG R971, LG N971, LY N971, LG Q971, LY Q971, LO R971, LY R971 LH N974, LH R974 LS Q976, LO Q976, LY Q976 LO Q996 - Hyper CHIPLED LW Q18S LB Q993, LB Q99A, LB R99A - SideLED LS A670, LO A670, LY A670, LG A670, LP A670 LB A673, LV A673, LT A673, LW A673 LH A674 LY A675 LS A676, LA A676, LO A676, LY A676, LW A676 LS A679, LY A679, LG A679 - Hyper Micro SIDELED® LS Y876, LA Y876, LO Y876, LY Y876 LT Y87S - SmartLED LW L88C, LW L88S LB L89C, LB L89S, LG L890 LS L89K, LO L89K, LY L89K LS L896, LA L896, LO L896, LY L896 - TOPLED LS T670, LO T670, LY T670, LG T670, LP T670 LSG T670, LSP T670, LSY T670, LOP T670, LYG T670 LG T671, LOG T671, LSG T671 LB T673, LV T673, LT T673, LW T673 LH T674 LS T676, LA T676, LO T676, LY T676, LB T676, LH T676, LSB T676, LW T676 LB T67C, LV T67C, LT T67C, LS T67K, LO T67K, LY T67K, LW E67C LS E67B, LA E67B, LO E67B, LY E67B, LB E67C, LV E67C, LT E67C LW T67C LS T679, LY T679, LG T679 LS T770, LO T770, LY T770, LG T770, LP T770 LB T773, LV T773, LT T773, LW T773 LH T774 LS E675, LA E675, LY E675, LS T675 LS T776, LA T776, LO T776, LY T776, LB T776 LHGB T686 LT T68C, LB T68C - Hyper Mini TOPLED® LB M676 - Mini TOPLED Santana® LG M470 LS M47K, LO M47K, LY M47K Source: http://www.osram.convergy.de LUXEON: - LUMILED® LXK2-PW12-R00, LXK2-PW12-S00, LXK2-PW14-U00, LXK2-PW14-V00 LXK2-PM12-R00, LXK2-PM12-S00, LXK2-PM14-U00 LXK2-PE12-Q00, LXK2-PE12-R00, LXK2-PE12-S00, LXK2-PE14-T00, LXK2-PE14-U00 LXK2-PB12-K00, LXK2-PB12-L00, LXK2-PB12-M00, LXK2-PB14-N00, LXK2-PB14-P00, LXK2-PB14-Q00 LXK2-PR12-L00, LXK2-PR12-M00, LXK2-PR14-Q00, LXK2-PR14-R00 LXK2-PD12-Q00, LXK2-PD12-R00, LXK2-PD12-S00 LXK2-PH12-R00, LXK2-PH12-S00 LXK2-PL12-P00, LXK2-PL12-Q00, LXK2-PL12-R00 Source: www.luxeon.com KINGBRIGHT: KA-3528ASYC Source: www.kingbright.com
Q1 = dragino:NMOSFET: MOS FET; OC_FARNELL: unknown; OC_NEWARK: unknown
R1-R11 R13-R16 R19-R21 R23-R25 R29-R36 R41 R46 R55-R57 R81-R86 = dragino:R-US_: RESISTOR, American symbol
RN1 RN2 = resistor-dil:4R-N: Array Chip Resistor Source: RS Component / Phycomp; OC_FARNELL: unknown; OC_NEWARK: unknown
ROUTER = dragino:MA08-2: PIN HEADER; OC_FARNELL: unknown; OC_NEWARK: unknown
S1 = dragino:PUSH_SWITCH: PUSH SWITCH ITT-Cannon-Cannon
SCREW = dragino:MA07-2: PIN HEADER; OC_FARNELL: unknown; OC_NEWARK: unknown
SIM1 = dragino-passive:SIM_CARD_CON_8: SIM Card Module Source:http://www.jisen.cc/cpjs.asp?id=535
T1 = dragino:RJ45_TRANSFORMER_HST2038DR
T4 = zetex:NPNSOT323: NPN TRANSISTOR; MPN: DSS4160U-7; OC_FARNELL: 1710696; OC_NEWARK: 25R4558
U1 = dragino:HE
U2 U3 = dragino:RT7272
U4 = dragino:SMF05C
U5 = linear:MC33269ST*: Adjustable Output Low Dropout Voltage Regulator 800 mA Source: http://www.onsemi.com/pub/Collateral/MC33269-D.PDF
U6 = dragino:NC7WZ125: 3 state buffer: http://www.fairchildsemi.com/ds/NC/NC7WZ125.pdf
U12 = dragino:USB_HUB_FE1.1S
USB2 = dragino-passive:USB_C42562
X1 X2 = con-phoenix-350:1751293: MKDS 1/ 7-3,5 Printklemme Nennstrom: 10 A Bemessungsspannung: 160 V Raster: 3,5 mm Polzahl: 7 Montageart: Löten Anschlussart: Schraubanschluss Anschlussrichtung vom Leiter zur Platine: 0° Source: http://eshop.phoenixcontact.com .. 1751293.pdf; OC_FARNELL: unknown; OC_NEWARK: unknown
X3 = dragino-passive:CRYSTAL

## Net classes
0 default: width 0.203 mm, clearance 0.152 mm
1 power: width 0.61 mm, drill 0.406 mm, clearance 0.254 mm
2 gnd: width 0.305 mm, drill 0.33 mm, clearance 0.254 mm
3 usbvcc: width 0.508 mm, drill 0.61 mm, clearance 0.254 mm
4 aref: width 0.406 mm, drill 0.61 mm, clearance 0.254 mm
6 usbtrace-4layer: width 0.191 mm, clearance 0.203 mm